# Altium schematic sheet schematic1.SchDoc (part 1 of 3) (continued)
## Parts (continued)
J?#10  D Connector 9  [DSUB1.385-2H9]
J?#11  D Connector 9  [DSUB1.385-2H9]
J?#12  D Connector 9  [DSUB1.385-2H9]
J?#13  D Connector 9  [DSUB1.385-2H9]
J?#14  D Connector 9  [DSUB1.385-2H9]
J?#15  D Connector 9  [DSUB1.385-2H9]
J?#16  D Connector 9  [DSUB1.385-2H9]
p1  Header 30  [HDR1X30]  (value not drawn)
P2  Header 30  [HDR1X30]  (value not drawn)
P3  Header 30  [HDR1X30]  (value not drawn)
P4  Header 10  [HDR1X10]
p5  Header 30  [HDR1X30]  (value not drawn)
P?#1  Header 10  [HDR1X10]
p?#2  Header 30  [HDR1X30]  (value not drawn)
p?#3  Header 30  [HDR1X30]  (value not drawn)
p?#4  Header 30  [HDR1X30]  (value not drawn)
P?#5  Header 10  [HDR1X10]
p?#6  Header 30  [HDR1X30]  (value not drawn)
p?#7  Header 30  [HDR1X30]  (value not drawn)
P?#8  Header 10  [HDR1X10]
p?#9  Header 30  [HDR1X30]  (value not drawn)
p?#10  Header 30  [HDR1X30]  (value not drawn)
p?#11  Header 30  [HDR1X30]  (value not drawn)
Q?#1  MOSFET-N  [SOT23]
Q?#2  MOSFET-N  [SOT23]
Q?#3  MOSFET-N  [SOT23]
Q?#4  MOSFET-N  [SOT23]
Q?#5  MOSFET-N  [SOT23]
Q?#6  MOSFET-N  [SOT23]
Q?#7  MOSFET-N  [SOT23]
Q?#8  MOSFET-N  [SOT23]
Q?#9  MOSFET-N  [SOT23]
Q?#10  MOSFET-N  [SOT23]
Q?#11  MOSFET-N  [SOT23]
Q?#12  MOSFET-N  [SOT23]
Q?#13  MOSFET-N  [SOT23]
Q?#14  MOSFET-N  [SOT23]
Q?#15  MOSFET-N  [SOT23]
Q?#16  MOSFET-N  [SOT23]
Q?#17  MOSFET-N  [SOT23]
Q?#18  MOSFET-N  [SOT23]
Q?#19  MOSFET-N  [SOT23]
Q?#20  MOSFET-N  [SOT23]
Q?#21  MOSFET-N  [SOT23]
Q?#22  MOSFET-N  [SOT23]
Q?#23  MOSFET-N  [SOT23]
Q?#24  MOSFET-N  [SOT23]
Q?#25  MOSFET-N  [SOT23]
Q?#26  MOSFET-N  [SOT23]
Q?#27  MOSFET-N  [SOT23]
Q?#28  MOSFET-N  [SOT23]
Q?#29  MOSFET-N  [SOT23]
Q?#30  MOSFET-N  [SOT23]
Q?#31  MOSFET-N  [SOT23]
Q?#32  MOSFET-N  [SOT23]
Q?#33  MOSFET-N  [SOT23]
Q?#34  MOSFET-N  [SOT23]
Q?#35  MOSFET-N  [SOT23]
Q?#36  MOSFET-N  [SOT23]
Q?#37  MOSFET-N  [SOT23]
Q?#38  MOSFET-N  [SOT23]
Q?#39  MOSFET-N  [SOT23]
Q?#40  MOSFET-N  [SOT23]
Q?#41  MOSFET-N  [SOT23]
Q?#42  MOSFET-N  [SOT23]
Q?#43  MOSFET-N  [SOT23]
Q?#44  MOSFET-N  [SOT23]
Q?#45  MOSFET-N  [SOT23]
Q?#46  MOSFET-N  [SOT23]
Q?#47  MOSFET-N  [SOT23]
Q?#48  MOSFET-N  [SOT23]
Q?#49  MOSFET-N  [SOT23]
Q?#50  MOSFET-N  [SOT23]
Q?#51  MOSFET-N  [SOT23]
Q?#52  MOSFET-N  [SOT23]
Q?#53  MOSFET-N  [SOT23]
Q?#54  MOSFET-N  [SOT23]
Q?#55  MOSFET-N  [SOT23]
Q?#56  MOSFET-N  [SOT23]
Q?#57  MOSFET-N  [SOT23]
Q?#58  MOSFET-N  [SOT23]
Q?#59  MOSFET-N  [SOT23]
Q?#60  MOSFET-N  [SOT23]
Q?#61  MOSFET-N  [SOT23]
Q?#62  MOSFET-N  [SOT23]
Q?#63  MOSFET-N  [SOT23]
Q?#64  MOSFET-N  [SOT23]
Q?#65  MOSFET-N  [SOT23]
Q?#66  MOSFET-N  [SOT23]
Q?#67  MOSFET-N  [SOT23]
Q?#68  MOSFET-N  [SOT23]
Q?#69  MOSFET-N  [SOT23]
Q?#70  MOSFET-N  [SOT23]
Q?#71  MOSFET-N  [SOT23]
Q?#72  MOSFET-N  [SOT23]
Q?#73  MOSFET-N  [SOT23]
Q?#74  MOSFET-N  [SOT23]
Q?#75  MOSFET-N  [SOT23]
Q?#76  MOSFET-N  [SOT23]
Q?#77  MOSFET-N  [SOT23]
Q?#78  MOSFET-N  [SOT23]
Q?#79  MOSFET-N  [SOT23]
Q?#80  MOSFET-N  [SOT23]
Q?#81  MOSFET-N  [SOT23]
Q?#82  MOSFET-N  [SOT23]
Q?#83  MOSFET-N  [SOT23]
Q?#84  MOSFET-N  [SOT23]
Q?#85  MOSFET-N  [SOT23]
Q?#86  MOSFET-N  [SOT23]
Q?#87  MOSFET-N  [SOT23]
Q?#88  MOSFET-N  [SOT23]
Q?#89  MOSFET-N  [SOT23]
Q?#90  MOSFET-N  [SOT23]
Q?#91  MOSFET-N  [SOT23]
Q?#92  MOSFET-N  [SOT23]
Q?#93  MOSFET-N  [SOT23]
Q?#94  MOSFET-N  [SOT23]
Q?#95  MOSFET-N  [SOT23]
Q?#96  MOSFET-N  [SOT23]
Q?#97  MOSFET-N  [SOT23]
Q?#98  MOSFET-N  [SOT23]
Q?#99  MOSFET-N  [SOT23]
Q?#100  MOSFET-N  [SOT23]
R?#1  10K  [0603]
R?#2  10K  [0603]
R?#3  10K  [0603]
R?#4  10K  [0603]
R?#5  10K  [0603]
R?#6  10K  [0603]
R?#7  10K  [0603]
R?#8  10K  [0603]
R?#9  10K  [0603]
R?#10  10K  [0603]
R?#11  10K  [0603]
R?#12  10K  [0603]
R?#13  10K  [0603]
R?#14  10K  [0603]
R?#15  10K  [0603]
R?#16  10K  [0603]
R?#17  10K  [0603]
R?#18  10K  [0603]
R?#19  10K  [0603]
R?#20  10K  [0603]
R?#21  10K  [0603]
R?#22  10K  [0603]
R?#23  10K  [0603]
R?#24  10K  [0603]
R?#25  10K  [0603]
R?#26  10K  [0603]
R?#27  10K  [0603]
R?#28  10K  [0603]
R?#29  10K  [0603]
R?#30  10K  [0603]
R?#31  10K  [0603]
R?#32  10K  [0603]
R?#33  10K  [0603]
R?#34  10K  [0603]
R?#35  10K  [0603]
R?#36  10K  [0603]
R?#37  10K  [0603]
R?#38  10K  [0603]
R?#39  10K  [0603]
R?#40  10K  [0603]
R?#41  10K  [0603]
R?#42  10K  [0603]
R?#43  10K  [0603]
R?#44  10K  [0603]
R?#45  10K  [0603]
R?#46  10K  [0603]
R?#47  10K  [0603]
R?#48  10K  [0603]
R?#49  10K  [0603]
R?#50  10K  [0603]
R?#51  10K  [0603]
R?#52  10K  [0603]
R?#53  10K  [0603]
R?#54  10K  [0603]
R?#55  10K  [0603]
R?#56  10K  [0603]
R?#57  10K  [0603]
R?#58  10K  [0603]
R?#59  10K  [0603]
R?#60  10K  [0603]
R?#61  10K  [0603]
R?#62  10K  [0603]
R?#63  10K  [0603]
R?#64  10K  [0603]
R?#65  10K  [0603]
R?#66  10K  [0603]
R?#67  10K  [0603]
R?#68  10K  [0603]
R?#69  10K  [0603]
R?#70  10K  [0603]
R?#71  10K  [0603]
R?#72  10K  [0603]
R?#73  10K  [0603]
R?#74  10K  [0603]
R?#75  10K  [0603]
R?#76  10K  [0603]
R?#77  10K  [0603]
R?#78  10K  [0603]
R?#79  10K  [0603]
R?#80  10K  [0603]
R?#81  10K  [0603]
R?#82  10K  [0603]
R?#83  10K  [0603]
R?#84  10K  [0603]
R?#85  10K  [0603]
R?#86  10K  [0603]
R?#87  10K  [0603]
R?#88  10K  [0603]
R?#89  10K  [0603]
R?#90  10K  [0603]
R?#91  10K  [0603]
R?#92  10K  [0603]
R?#93  10K  [0603]
R?#94  10K  [0603]
R?#95  10K  [0603]
R?#96  10K  [0603]
R?#97  10K  [0603]
R?#98  10K  [0603]
R?#99  10K  [0603]
R?#100  10K  [0603]
R?#101  10K  [0603]
R?#102  10K  [0603]
R?#103  10K  [0603]
R?#104  10K  [0603]
R?#105  10K  [0603]
R?#106  10K  [0603]
R?#107  10K  [0603]
R?#108  10K  [0603]
R?#109  10K  [0603]
R?#110  10K  [0603]
R?#111  10K  [0603]
R?#112  10K  [0603]
R?#113  10K  [0603]
R?#114  10K  [0603]
R?#115  10K  [0603]
R?#116  10K  [0603]
R?#117  10K  [0603]
R?#118  10K  [0603]
R?#119  10K  [0603]
R?#120  10K  [0603]
R?#121  10K  [0603]
R?#122  10K  [0603]
R?#123  10K  [0603]
R?#124  10K  [0603]
R?#125  10K  [0603]
R?#126  10K  [0603]
R?#127  10K  [0603]
R?#128  10K  [0603]
R?#129  10K  [0603]
R?#130  10K  [0603]
R?#131  10K  [0603]
R?#132  10k  [RESC2012X65N]
R?#133  10K  [0603]
R?#134  10K  [0603]
R?#135  10K  [0603]
R?#136  10K  [0603]
R?#137  10K  [0603]
R?#138  10K  [0603]
R?#139  10K  [0603]
R?#140  24  [RESC0603X28N]
R?#141  20k  [RES_ERJU06J203V]
R?#142  20k  [RES_ERJU06J203V]
R?#143  10K  [0603]
R?#144  10K  [0603]
R?#145  20k  [RES_ERJU06J203V]
R?#146  10K  [0603]
R?#147  10K  [0603]
R?#148  10K  [0603]
R?#149  10K  [0603]
R?#150  10K  [0603]
R?#151  10K  [0603]
R?#152  10K  [0603]
R?#153  10K  [0603]
R?#154  10K  [0603]
R?#155  10K  [0603]
R?#156  10K  [0603]
R?#157  20k  [RES_ERJU06J203V]
R?#158  10K  [0603]
R?#159  10K  [0603]
R?#160  100  [RES_ERJS06F1000V]
R?#161  10K  [0603]
R?#162  10K  [0603]
R?#163  10K  [0603]
R?#164  100  [RES_ERJS06F1000V]
R?#165  20k  [RES_ERJU06J203V]
R?#166  100  [RES_ERJS06F1000V]
R?#167  50  [RESC6331X64N]
R?#168  10K  [0603]
R?#169  20k  [RES_ERJU06J203V]
R?#170  10K  [0603]
R?#171  10K  [0603]
R?#172  Res1  value 55  [AXIAL-0.3]
R?#173  10K  [0603]
R?#174  Res1  value 55  [AXIAL-0.3]
R?#175  4.7k  [RES_ERJPA3D4701V]
R?#176  270  [RES_ERJU1DF2700U]
R?#177  20k  [RES_ERJU06J203V]
R?#178  100k  [RESC6331X70N]
R?#179  10K  [0603]
R?#180  10K  [0603]
R?#181  10K  [0603]
R?#182  10K  [0603]
R?#183  10K  [0603]
R?#184  10K  [0603]
R?#185  10K  [0603]
R?#186  10K  [0603]
R?#187  10K  [0603]
R?#188  10K  [0603]
R?#189  10K  [0603]
R?#190  10K  [0603]
R?#191  10K  [0603]
R?#192  10K  [0603]
R?#193  10K  [0603]
R?#194  10K  [0603]
R?#195  10K  [0603]
R?#196  10K  [0603]
R?#197  10K  [0603]
R?#198  100k  [RESC6331X70N]
R?#199  10k  [RESC2012X65N]
R?#200  10K  [0603]
R?#201  10K  [0603]
R?#202  10K  [0603]
R?#203  10K  [0603]
R?#204  10K  [0603]
R?#205  10K  [0603]
R?#206  10K  [0603]
R?#207  10K  [0603]
R?#208  10K  [0603]
R?#209  4.99k  [RESC6331X70N]
R?#210  10K  [0603]
R?#211  10K  [0603]
R?#212  10K  [0603]
R?#213  10K  [0603]
R?#214  10K  [0603]
R?#215  10K  [0603]
R?#216  10K  [0603]
R?#217  10K  [0603]
R?#218  10K  [0603]
R?#219  24  [RESC0603X28N]
R?#220  10K  [0603]
R?#221  10K  [0603]
R?#222  10K  [0603]
R?#223  10K  [0603]
R?#224  10K  [0603]
R?#225  10K  [0603]
R?#226  4.7k  [RES_ERJPA3D4701V]
R?#227  10K  [0603]
R?#228  10K  [0603]
R?#229  10K  [0603]
R?#230  100  [RES_ERJS06F1000V]
R?#231  10K  [0603]
R?#232  100  [RES_ERJS06F1000V]
R?#233  10K  [0603]
R?#234  10K  [0603]
R?#235  10K  [0603]
R?#236  10K  [0603]
R?#237  10K  [0603]
R?#238  10K  [0603]
R?#239  10K  [0603]
R?#240  10K  [0603]
R?#241  10K  [0603]
R?#242  10K  [0603]
R?#243  10K  [0603]
R?#244  10K  [0603]
R?#245  10K  [0603]
R?#246  10K  [0603]
R?#247  10K  [0603]
R?#248  10K  [0603]
R?#249  10K  [0603]
R?#250  10K  [0603]
R?#251  10K  [0603]
R?#252  10K  [0603]
R?#253  10K  [0603]
R?#254  10K  [0603]
R?#255  10K  [0603]
R?#256  10K  [0603]
R?#257  10K  [0603]
R?#258  10K  [0603]
R?#259  10K  [0603]
R?#260  10K  [0603]
R?#261  10K  [0603]
R?#262  10K  [0603]
R?#263  10K  [0603]
R?#264  10K  [0603]
R?#265  10K  [0603]
R?#266  10K  [0603]
R?#267  10K  [0603]
R?#268  10K  [0603]
R?#269  10K  [0603]
R?#270  10K  [0603]
R?#271  10K  [0603]
R?#272  10K  [0603]
R?#273  10K  [0603]
R?#274  10K  [0603]
R?#275  10K  [0603]
R?#276  10K  [0603]
R?#277  10K  [0603]
R?#278  10K  [0603]
R?#279  10K  [0603]
R?#280  10K  [0603]
R?#281  10K  [0603]
R?#282  10K  [0603]
R?#283  10K  [0603]
R?#284  10K  [0603]
R?#285  10K  [0603]
R?#286  10K  [0603]
R?#287  10K  [0603]
R?#288  10K  [0603]
R?#289  10K  [0603]
R?#290  10K  [0603]
R?#291  10K  [0603]
R?#292  10K  [0603]
R?#293  10K  [0603]
R?#294  10K  [0603]
R?#295  10K  [0603]
R?#296  10K  [0603]
R?#297  10K  [0603]
R?#298  10K  [0603]
R?#299  10K  [0603]
R?#300  10K  [0603]
R?#301  10K  [0603]
R?#302  10K  [0603]
R?#303  10K  [0603]
R?#304  10K  [0603]
R?#305  10K  [0603]
R?#306  10K  [0603]
R?#307  10K  [0603]
R?#308  10K  [0603]
R?#309  10K  [0603]
R?#310  10K  [0603]
R?#311  10K  [0603]
R?#312  10K  [0603]
R?#313  10K  [0603]
R?#314  10K  [0603]
R?#315  10K  [0603]
R?#316  10K  [0603]
R?#317  10K  [0603]
R?#318  10K  [0603]
R?#319  10K  [0603]
R?#320  10K  [0603]
R?#321  10K  [0603]
R?#322  10K  [0603]
R?#323  10K  [0603]
R?#324  10K  [0603]
R?#325  10K  [0603]
R?#326  10K  [0603]
R?#327  10K  [0603]
R?#328  10K  [0603]
R?#329  10K  [0603]
R?#330  10K  [0603]
R?#331  10K  [0603]
R?#332  10K  [0603]
R?#333  10K  [0603]
R?#334  10K  [0603]
R?#335  10K  [0603]
R?#336  10K  [0603]
R?#337  10K  [0603]
R?#338  10K  [0603]
R?#339  10K  [0603]
R?#340  10K  [0603]
R?#341  10K  [0603]
R?#342  10K  [0603]
R?#343  10K  [0603]
R?#344  10K  [0603]
R?#345  10K  [0603]
R?#346  10K  [0603]
R?#347  10K  [0603]
R?#348  10K  [0603]
R?#349  10K  [0603]
R?#350  10K  [0603]
R?#351  10K  [0603]
R?#352  10K  [0603]
R?#353  10K  [0603]
R?#354  10K  [0603]
R?#355  10K  [0603]
R?#356  10K  [0603]
R?#357  10K  [0603]
R?#358  10K  [0603]
R?#359  10K  [0603]
R?#360  10K  [0603]
R?#361  10K  [0603]
R?#362  10K  [0603]
R?#363  10K  [0603]
S1  SW-PB  [small Button]
S?#1  SW-PB  [small Button]
S?#2  FSM8JH  [SW_FSM8JH]
S?#3  SW-PB  [small Button]
S?#4  FSM8JH  [SW_FSM8JH]
U1  STM32F103V8T6  [LQFP100_L]
U2  STM32F103V8T6  [LQFP100_L]
U3  STM32F103V8T6  [LQFP100_L]
U4  AD5590BBCZ  [BGA80C80P12X12_1000X1000X150]
U5  AD5590BBCZ  [BGA80C80P12X12_1000X1000X150]
U6  AD5590BBCZ  [BGA80C80P12X12_1000X1000X150]
U7  AD5590BBCZ  [BGA80C80P12X12_1000X1000X150]
U8  AD5590BBCZ  [BGA80C80P12X12_1000X1000X150]
U9  AD5590BBCZ  [BGA80C80P12X12_1000X1000X150]
U10  AD5590BBCZ  [BGA80C80P12X12_1000X1000X150]
U11  MAX232  [SO16]
U12  MAX232  [SO16]
U13  MAX232  [SO16]
U14  MAX232  [SO16]
U15  MAX232  [SO16]
U?#1  (no value)  [CLG484]  (part G of 10)
U?#2  XC7Z020-1CLG484I  [CLG484]  (part H of 10)
U?#3  XC7Z020-1CLG484I  [CLG484]  (part J of 10)
U?#4  XC7Z020-1CLG484I  [CLG484]  (part I of 10)
U?#5  XC7Z020-1CLG484I  [CLG484]  (part F of 10)
U?#6  (no value)  [QFN50P700X700X100-49N]
U?#7  XC7Z020-1CLG484I  [CLG484]  (part E of 10)
U?#8  S25FL256LAGNFV010  [FP-002-18827-MFG]
U?#9  ADP3330  [SOT457]  (value not drawn)
U?#10  ADP3330  [SOT457]  (value not drawn)
U?#11  ADP3330  [SOT457]  (value not drawn)
U?#12  ADP3330  [SOT457]  (value not drawn)
U?#13  ADP3330  [SOT457]  (value not drawn)
U?#14  ADP3330  [SOT457]  (value not drawn)
U?#15  ADP3330  [SOT457]  (value not drawn)
U?#16  ADP3330  [SOT457]  (value not drawn)
U?#17  ADP3330  [SOT457]  (value not drawn)
U?#18  ADP3330  [SOT457]  (value not drawn)
U?#19  ADP3330  [SOT457]  (value not drawn)
U?#20  ADP3330  [SOT457]  (value not drawn)
U?#21  ADP3330  [SOT457]  (value not drawn)
U?#22  ADP3330  [SOT457]  (value not drawn)
U?#23  ADP3330  [SOT457]  (value not drawn)
U?#24  ADP3330  [SOT457]  (value not drawn)
U?#25  ADP3330  [SOT457]  (value not drawn)
U?#26  ADP3330  [SOT457]  (value not drawn)
U?#27  ADP3330  [SOT457]  (value not drawn)
U?#28  ADP3330  [SOT457]  (value not drawn)
U?#29  ADP3330  [SOT457]  (value not drawn)
U?#30  ADP3330  [SOT457]  (value not drawn)
U?#31  ADP3330  [SOT457]  (value not drawn)
U?#32  ADP3330  [SOT457]  (value not drawn)
U?#33  ADP3330  [SOT457]  (value not drawn)
U?#34  ADP3330  [SOT457]  (value not drawn)
U?#35  ADP3330  [SOT457]  (value not drawn)
U?#36  ADP3330  [SOT457]  (value not drawn)
U?#37  ADP3330  [SOT457]  (value not drawn)
U?#38  ADP3330  [SOT457]  (value not drawn)
U?#39  ADP3330  [SOT457]  (value not drawn)
U?#40  ADP3330  [SOT457]  (value not drawn)
U?#41  ADP3330  [SOT457]  (value not drawn)
U?#42  ADP3330  [SOT457]  (value not drawn)
U?#43  ADP3330  [SOT457]  (value not drawn)
U?#44  ADP3330  [SOT457]  (value not drawn)
U?#45  ADP3330  [SOT457]  (value not drawn)
U?#46  ADP3330  [SOT457]  (value not drawn)
U?#47  ADP3330  [SOT457]  (value not drawn)
U?#48  ADP3330  [SOT457]  (value not drawn)
U?#49  ADP3330  [SOT457]  (value not drawn)
U?#50  ADP3330  [SOT457]  (value not drawn)
U?#51  ADP3330  [SOT457]  (value not drawn)
U?#52  ADP3330  [SOT457]  (value not drawn)
U?#53  ADP3330  [SOT457]  (value not drawn)
U?#54  ADP3330  [SOT457]  (value not drawn)
U?#55  ADP3330  [SOT457]  (value not drawn)
U?#56  ADP3330  [SOT457]  (value not drawn)
U?#57  ADP3330  [SOT457]  (value not drawn)
U?#58  ADP3330  [SOT457]  (value not drawn)
U?#59  ADP3330  [SOT457]  (value not drawn)
U?#60  ADP3330  [SOT457]  (value not drawn)
U?#61  ADP3330  [SOT457]  (value not drawn)
U?#62  ADP3330  [SOT457]  (value not drawn)
U?#63  ADP3330  [SOT457]  (value not drawn)
U?#64  ADP3330  [SOT457]  (value not drawn)
U?#65  ADP3330  [SOT457]  (value not drawn)
U?#66  ADP3330  [SOT457]  (value not drawn)
U?#67  ADP3330  [SOT457]  (value not drawn)
U?#68  ADP3330  [SOT457]  (value not drawn)
U?#69  ADP3330  [SOT457]  (value not drawn)
U?#70  ADP3330  [SOT457]  (value not drawn)
U?#71  ADP3330  [SOT457]  (value not drawn)
U?#72  ADP3330  [SOT457]  (value not drawn)
U?#73  ADP3330  [SOT457]  (value not drawn)
U?#74  ADP3330  [SOT457]  (value not drawn)
U?#75  ADP3330  [SOT457]  (value not drawn)
U?#76  ADP3330  [SOT457]  (value not drawn)
U?#77  ADP3330  [SOT457]  (value not drawn)
U?#78  ADP3330  [SOT457]  (value not drawn)
U?#79  ADP3330  [SOT457]  (value not drawn)
U?#80  ADP3330  [SOT457]  (value not drawn)
U?#81  ADP3330  [SOT457]  (value not drawn)
U?#82  ADP3330  [SOT457]  (value not drawn)
U?#83  ADP3330  [SOT457]  (value not drawn)
U?#84  ADP3330  [SOT457]  (value not drawn)
U?#85  ADP3330  [SOT457]  (value not drawn)
U?#86  ADP3330  [SOT457]  (value not drawn)
U?#87  ADP3330  [SOT457]  (value not drawn)
U?#88  ADP3330  [SOT457]  (value not drawn)
U?#89  ADP3330  [SOT457]  (value not drawn)
U?#90  ADP3330  [SOT457]  (value not drawn)
U?#91  ADP3330  [SOT457]  (value not drawn)
U?#92  ADP3330  [SOT457]  (value not drawn)
U?#93  ADP3330  [SOT457]  (value not drawn)
U?#94  ADP3330  [SOT457]  (value not drawn)
U?#95  ADP3330  [SOT457]  (value not drawn)
U?#96  ADP3330  [SOT457]  (value not drawn)
U?#97  ADP3330  [SOT457]  (value not drawn)
U?#98  ADP3330  [SOT457]  (value not drawn)
U?#99  ADP3330  [SOT457]  (value not drawn)
U?#100  ADP3330  [SOT457]  (value not drawn)
U?#101  ADP3330  [SOT457]  (value not drawn)
U?#102  ADP3330  [SOT457]  (value not drawn)
U?#103  ADP3330  [SOT457]  (value not drawn)
U?#104  ADP3330  [SOT457]  (value not drawn)
U?#105  ADP3330  [SOT457]  (value not drawn)
U?#106  ADP3330  [SOT457]  (value not drawn)
U?#107  ADP3330  [SOT457]  (value not drawn)
U?#108  ADP3330  [SOT457]  (value not drawn)
U?#109  ADP3330  [SOT457]  (value not drawn)
U?#110  ADP3330  [SOT457]  (value not drawn)
U?#111  ADP3330  [SOT457]  (value not drawn)
U?#112  ADP3330  [SOT457]  (value not drawn)
U?#113  ADP3330  [SOT457]  (value not drawn)
U?#114  ADP3330  [SOT457]  (value not drawn)
U?#115  ADP3330  [SOT457]  (value not drawn)
U?#116  ADP3330  [SOT457]  (value not drawn)
U?#117  ADP3330  [SOT457]  (value not drawn)
U?#118  ADP3330  [SOT457]  (value not drawn)
U?#119  ADP3330  [SOT457]  (value not drawn)
U?#120  ADP3330  [SOT457]  (value not drawn)
U?#121  ADP3330  [SOT457]  (value not drawn)
U?#122  ADP3330  [SOT457]  (value not drawn)
U?#123  ADP3330  [SOT457]  (value not drawn)
U?#124  ADP3330  [SOT457]  (value not drawn)
U?#125  ADP3330  [SOT457]  (value not drawn)
U?#126  ADP3330  [SOT457]  (value not drawn)
U?#127  ADP3330  [SOT457]  (value not drawn)
U?#128  ADP3330  [SOT457]  (value not drawn)
U?#129  ADP3330  [SOT457]  (value not drawn)
U?#130  ADP3330  [SOT457]  (value not drawn)
U?#131  ADP3330  [SOT457]  (value not drawn)
U?#132  ADP3330  [SOT457]  (value not drawn)
U?#133  ADP3330  [SOT457]  (value not drawn)
U?#134  ADP3330  [SOT457]  (value not drawn)
U?#135  ADP3330  [SOT457]  (value not drawn)
U?#136  ADP3330  [SOT457]  (value not drawn)
U?#137  ADP3330  [SOT457]  (value not drawn)
U?#138  ADP3330  [SOT457]  (value not drawn)
U?#139  ADP3330  [SOT457]  (value not drawn)
U?#140  ADP3330  [SOT457]  (value not drawn)
U?#141  ADP3330  [SOT457]  (value not drawn)
U?#142  ADP3330  [SOT457]  (value not drawn)
U?#143  ADP3330  [SOT457]  (value not drawn)
U?#144  ADP3330  [SOT457]  (value not drawn)
U?#145  ADP3330  [SOT457]  (value not drawn)
U?#146  ADP3330  [SOT457]  (value not drawn)
U?#147  ADP3330  [SOT457]  (value not drawn)
U?#148  ADP3330  [SOT457]  (value not drawn)
U?#149  ADP3330  [SOT457]  (value not drawn)
U?#150  ADP3330  [SOT457]  (value not drawn)
U?#151  ADP3330  [SOT457]  (value not drawn)
U?#152  ADP3330  [SOT457]  (value not drawn)
U?#153  ADP3330  [SOT457]  (value not drawn)
U?#154  ADP3330  [SOT457]  (value not drawn)
U?#155  ADP3330  [SOT457]  (value not drawn)
U?#156  ADP3330  [SOT457]  (value not drawn)
U?#157  ADP3330  [SOT457]  (value not drawn)
U?#158  ADP3330  [SOT457]  (value not drawn)
U?#159  ADP3330  [SOT457]  (value not drawn)
U?#160  ADP3330  [SOT457]  (value not drawn)
U?#161  ADP3330  [SOT457]  (value not drawn)
U?#162  ADP3330  [SOT457]  (value not drawn)
U?#163  ADP3330  [SOT457]  (value not drawn)
U?#164  ADP3330  [SOT457]  (value not drawn)
U?#165  ADP3330  [SOT457]  (value not drawn)
U?#166  ADP3330  [SOT457]  (value not drawn)
U?#167  ADP3330  [SOT457]  (value not drawn)
U?#168  ADP3330  [SOT457]  (value not drawn)
U?#169  ADP3330  [SOT457]  (value not drawn)
U?#170  ADP3330  [SOT457]  (value not drawn)
U?#171  ADP3330  [SOT457]  (value not drawn)
U?#172  ADP3330  [SOT457]  (value not drawn)
U?#173  ADP3330  [SOT457]  (value not drawn)
U?#174  ADP3330  [SOT457]  (value not drawn)
U?#175  ADP3330  [SOT457]  (value not drawn)
U?#176  ADP3330  [SOT457]  (value not drawn)
U?#177  ADP3330  [SOT457]  (value not drawn)
U?#178  ADP3330  [SOT457]  (value not drawn)
U?#179  ADP3330  [SOT457]  (value not drawn)
U?#180  ADP3330  [SOT457]  (value not drawn)
U?#181  ADP3330  [SOT457]  (value not drawn)
U?#182  ADP3330  [SOT457]  (value not drawn)
U?#183  ADP3330  [SOT457]  (value not drawn)
U?#184  ADP3330  [SOT457]  (value not drawn)
U?#185  ADP3330  [SOT457]  (value not drawn)
U?#186  ADP3330  [SOT457]  (value not drawn)
U?#187  ADP3330  [SOT457]  (value not drawn)
U?#188  ADP3330  [SOT457]  (value not drawn)
U?#189  ADP3330  [SOT457]  (value not drawn)
U?#190  ADP3330  [SOT457]  (value not drawn)
U?#191  ADP3330  [SOT457]  (value not drawn)
U?#192  ADP3330  [SOT457]  (value not drawn)
U?#193  ADP3330  [SOT457]  (value not drawn)
U?#194  ADP3330  [SOT457]  (value not drawn)
U?#195  ADP3330  [SOT457]  (value not drawn)
U?#196  ADP3330  [SOT457]  (value not drawn)
U?#197  ADP3330  [SOT457]  (value not drawn)
U?#198  ADP3330  [SOT457]  (value not drawn)
U?#199  ADP3330  [SOT457]  (value not drawn)
U?#200  ADP3330  [SOT457]  (value not drawn)
U?#201  ADP3330  [SOT457]  (value not drawn)
U?#202  ADP3330  [SOT457]  (value not drawn)
U?#203  ADP3330  [SOT457]  (value not drawn)
U?#204  ADP3330  [SOT457]  (value not drawn)
U?#205  ADP3330  [SOT457]  (value not drawn)
U?#206  ADP3330  [SOT457]  (value not drawn)
U?#207  ADP3330  [SOT457]  (value not drawn)
U?#208  ADP3330  [SOT457]  (value not drawn)
Y1  16Mhz  [Crystal]
Y?#1  16Mhz  [Crystal]
Y?#2  25MHZ  [OSC_XRCGB25M000F3M04R0]
Y?#3  16Mhz  [Crystal]
Y?#4  ECS-2520MV-333.3-BN-TR  [OSC_ECS-2520S25-250-FN-TR]

## Blocks framed on the sheet
digital I/O s: p1 P2-P4 P?#1 p?#2-p?#4
DAC / ADC: C?#174-C?#191 C?#200-C?#207 C?#210-C?#217 C?#219-C?#226 R?#233-R?#238 R?#249-R?#251 R?#286-R?#289 R?#300-R?#307 U4-U10
RS422_CONNECTION: C?#192-C?#199 C?#208 C?#209 C?#218 C?#227-C?#235 J1 J2 J?#9-J?#16 R?#262 R?#263 R?#279 R?#285 R?#308 R?#309 R?#330 R?#331 R?#342 R?#343 U11-U15

## Ports
ETH-MDC (bidir), ETH-MDIO (bidir), ETH-RXCK (bidir), ETH-RXCTL (bidir), ETH-RXD0 (bidir), ETH-RXD1 (bidir), ETH-RXD2 (bidir), ETH-RXD3 (bidir), ETH-TXCK (out), ETH-TXCTL (bidir), ETH-TXD0 (bidir), ETH-TXD1 (bidir), ETH-TXD2 (bidir), ETH-TXD3 (bidir), ETH_TXCK (bidir)